# EasyEDA Pro project ProProject_IMUSensorNodes202312.epro, board 6_6_拼板20240123（不带编号） (continued)
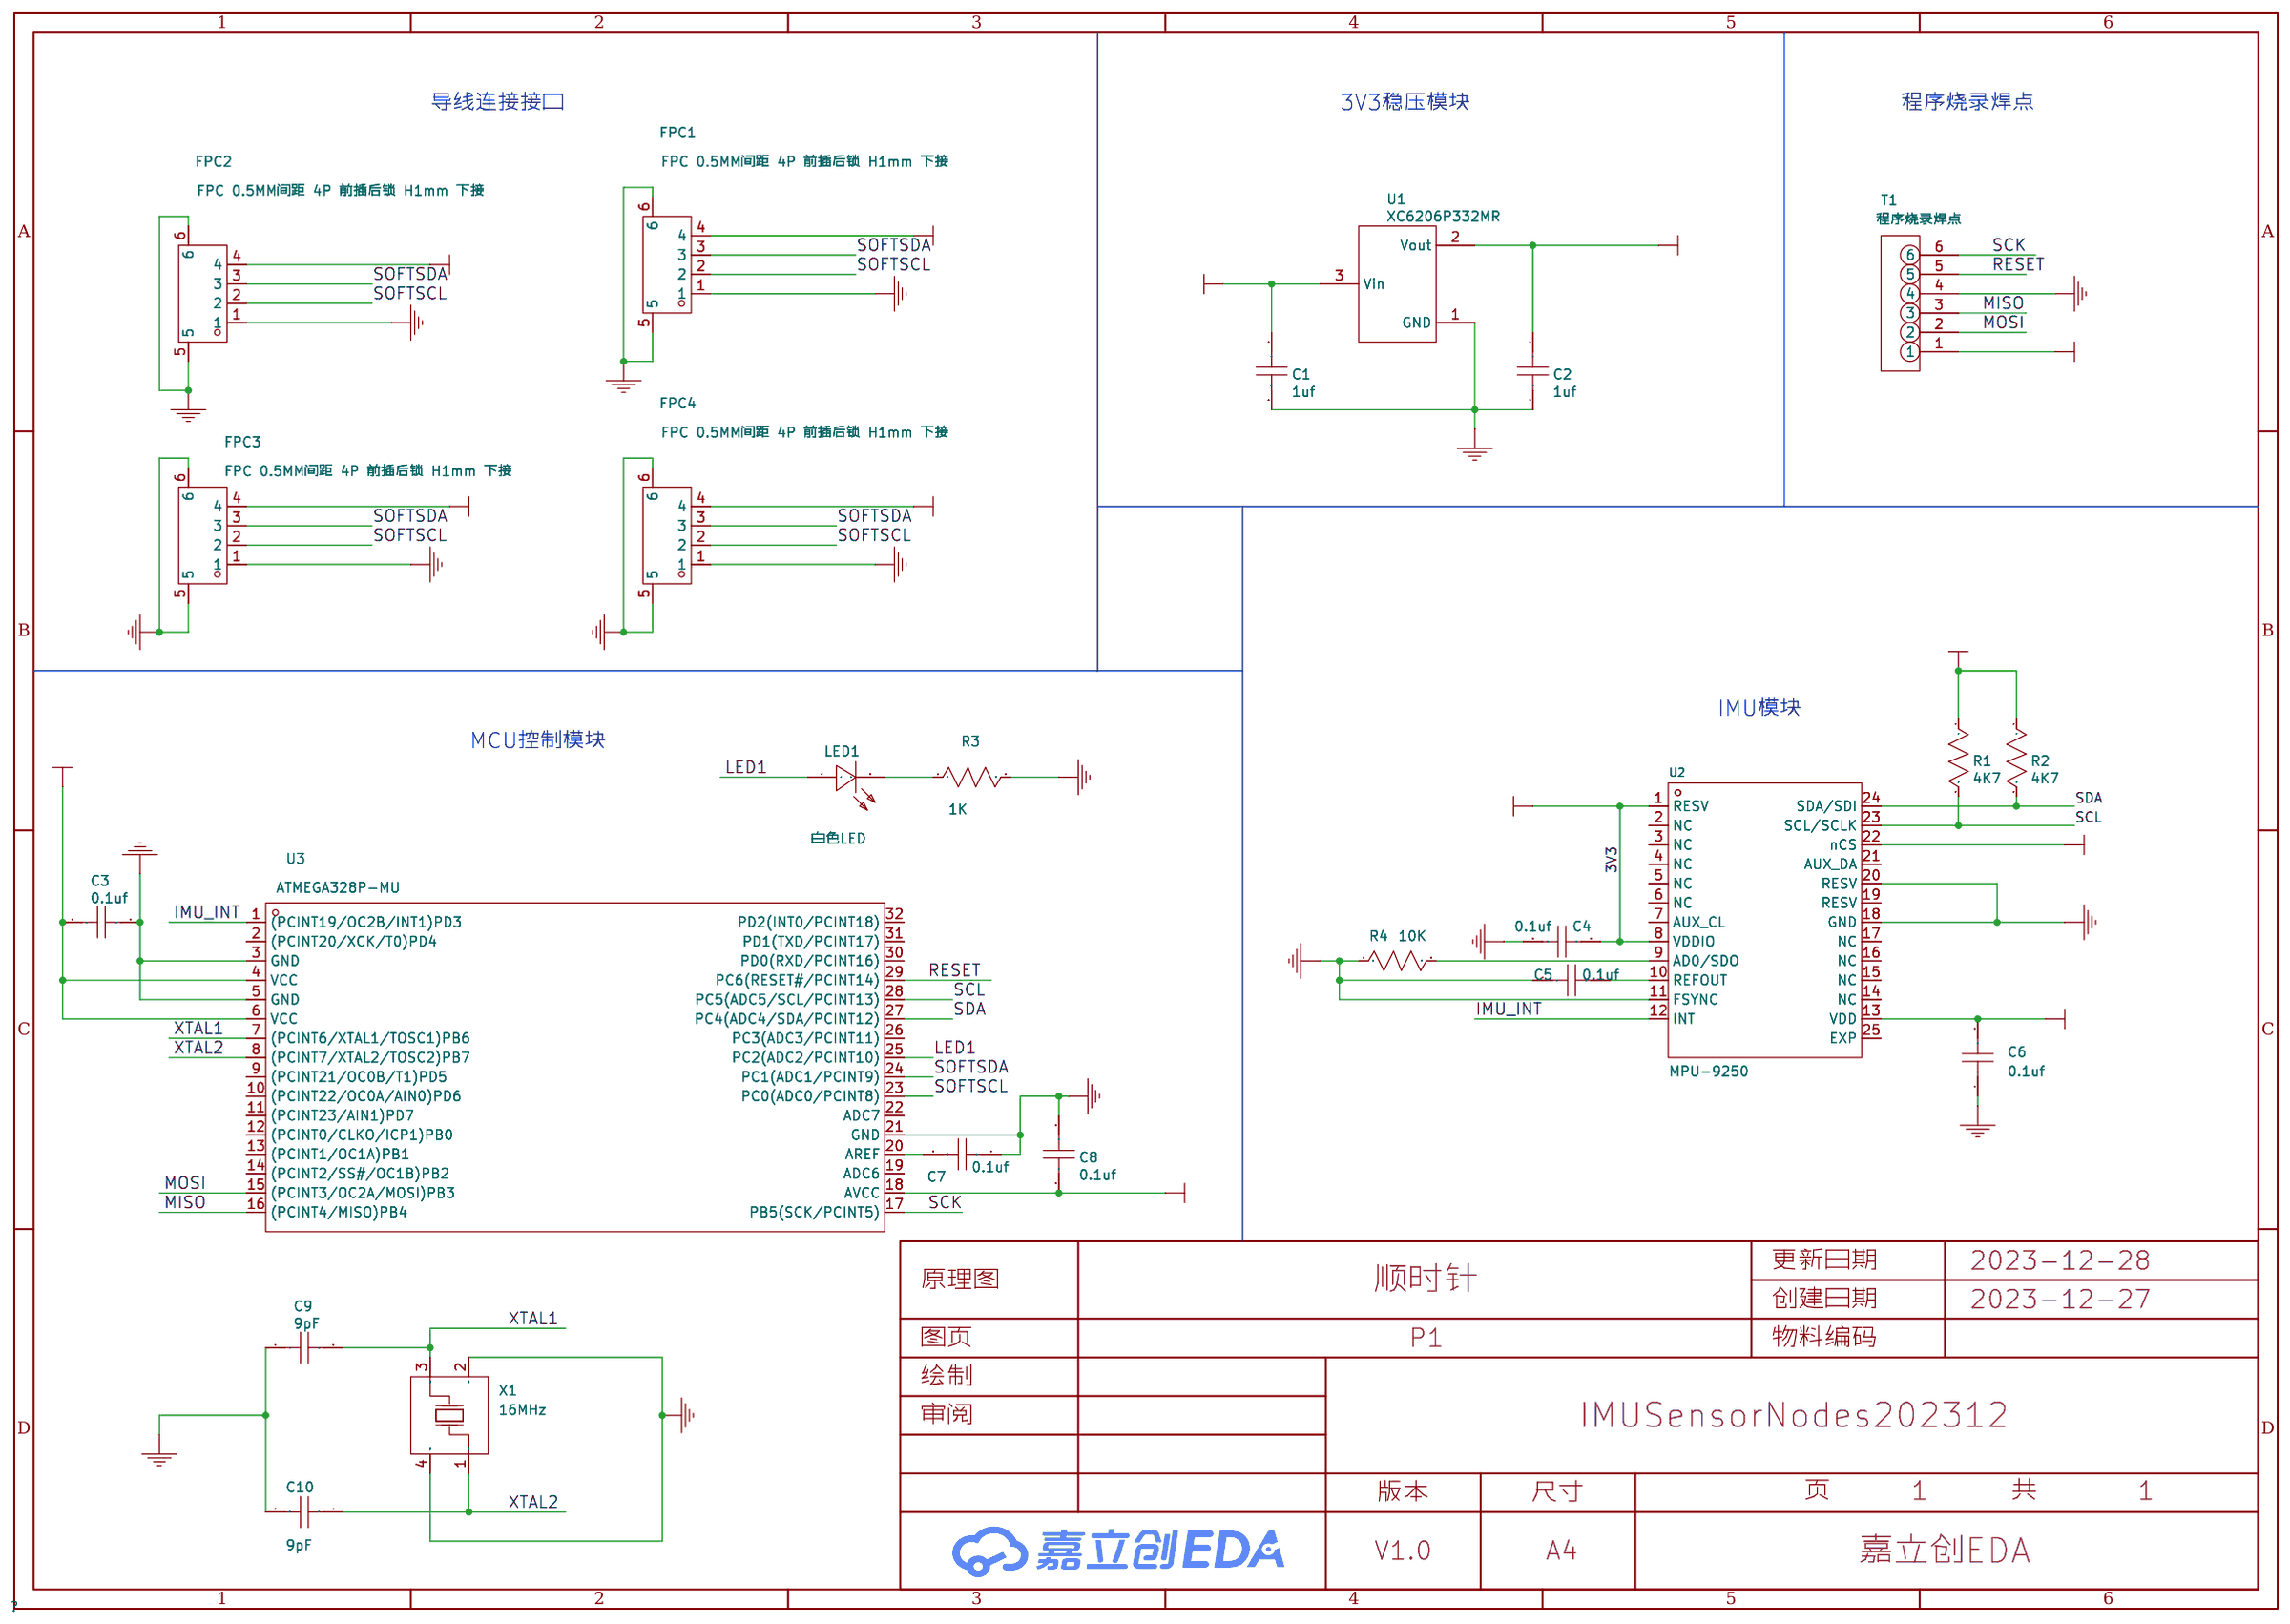
[diagram p0: schematic sheet]
## Routing (per net, layer and track width the routed paths; a pad name or vN(x,y) marks a point on that pad's centre or on a via; arc(x,y) is an arc through that point) (continued)
LED1:
  vias: v1(1.17,70.77) v1(1.17,57.05) v1(1.17,43.34) v1(1.17,29.62) v1(1.17,15.9) v1(1.17,2.19) v1(15.14,70.39) v1(15.14,56.67) v1(15.14,42.95) v1(15.14,29.24) v1(15.14,15.52) v1(15.14,1.81) v1(28.48,70.77) v1(28.48,57.05) v1(28.48,43.34) v1(28.48,29.62) v1(28.48,15.9) v1(28.48,2.19) v1(42.45,70.39) v1(42.45,56.67) v1(42.45,42.95) v1(42.45,29.24) v1(42.45,15.52) v1(42.45,1.81) v1(55.78,70.77) v1(55.78,57.05) v1(55.78,43.34) v1(55.78,29.62) v1(55.78,15.9) v1(55.78,2.19) v1(69.75,70.39) v1(69.75,56.67) v1(69.75,42.95) v1(69.75,29.24) v1(69.75,15.52) v1(69.75,1.81)
MISO:
  vias: v1(9.4,70.44) v1(9.4,56.72) v1(9.4,43) v1(9.4,29.29) v1(9.4,15.57) v1(9.4,1.86) v1(23.12,70.44) v1(23.12,56.72) v1(23.12,43) v1(23.12,29.29) v1(23.12,15.57) v1(23.12,1.86) v1(36.71,70.44) v1(36.71,56.72) v1(36.71,43) v1(36.71,29.29) v1(36.71,15.57) v1(36.71,1.86) v1(50.42,70.44) v1(50.42,56.72) v1(50.42,43) v1(50.42,29.29) v1(50.42,15.57) v1(50.42,1.86) v1(64.01,70.44) v1(64.01,56.72) v1(64.01,43) v1(64.01,29.29) v1(64.01,15.57) v1(64.01,1.86) v1(77.73,70.44) v1(77.73,56.72) v1(77.73,43) v1(77.73,29.29) v1(77.73,15.57) v1(77.73,1.86)
MOSI:
  vias: v1(9.4,71.71) v1(9.4,57.99) v1(9.4,44.27) v1(9.4,30.56) v1(9.4,16.84) v1(9.4,3.13) v1(23.12,71.71) v1(23.12,57.99) v1(23.12,44.27) v1(23.12,30.56) v1(23.12,16.84) v1(23.12,3.13) v1(36.71,71.71) v1(36.71,57.99) v1(36.71,44.27) v1(36.71,30.56) v1(36.71,16.84) v1(36.71,3.13) v1(50.42,71.71) v1(50.42,57.99) v1(50.42,44.27) v1(50.42,30.56) v1(50.42,16.84) v1(50.42,3.13) v1(64.01,71.71) v1(64.01,57.99) v1(64.01,44.27) v1(64.01,30.56) v1(64.01,16.84) v1(64.01,3.13) v1(77.73,71.71) v1(77.73,57.99) v1(77.73,44.27) v1(77.73,30.56) v1(77.73,16.84) v1(77.73,3.13)
RESET: length 163.4
  Top Layer w0.2: 77.88,55.53 78.39,56.04 78.39,57.38 v1(79,57.99) ; 50.58,0.66 51.09,1.17 51.09,2.52 v1(51.69,3.13) ; v1(79,44.27) 78.39,43.67 78.39,42.32 77.88,41.81 ; 77.88,28.1 78.39,28.6 78.39,29.95 v1(79,30.56) ; 77.88,14.38 78.39,14.89 78.39,16.23 v1(79,16.84) ; 23.27,69.24 23.78,69.75 23.78,71.1 v1(24.39,71.71) ; v1(70.52,72.93) 70.77,72.67 70.77,70.64 70.23,70.11 70.23,69.65 70.64,69.24 72.27,69.24 FPC4#16.5 ; FPC4#4.5 17.66,55.53 16.03,55.53 15.62,55.94 15.62,56.39 16.16,56.92 16.16,58.96 v1(15.91,59.21) ; v1(24.39,16.84) 23.78,16.23 23.78,14.89 23.27,14.38 ; FPC4#24.5 44.96,28.1 43.34,28.1 42.93,28.5 42.93,28.96 43.47,29.49 43.47,31.53 v1(43.21,31.78) ; v1(70.52,31.78) 70.77,31.53 70.77,29.49 70.23,28.96 70.23,28.5 70.64,28.1 72.27,28.1 FPC4#29.5 ; FPC4#2.5 44.96,0.66 43.34,0.66 42.93,1.07 42.93,1.53 43.47,2.06 43.47,4.09 v1(43.21,4.35) ; 50.58,41.81 51.09,42.32 51.09,43.67 v1(51.69,44.27) ; 50.58,28.1 51.09,28.6 51.09,29.95 v1(51.69,30.56) ; FPC4#28.5 17.66,14.38 16.03,14.38 15.62,14.79 15.62,15.24 16.16,15.78 16.16,17.81 v1(15.91,18.06) ; v1(79,71.71) 78.39,71.1 78.39,69.75 77.88,69.24 ; v1(51.69,16.84) 51.09,16.23 51.09,14.89 50.58,14.38 ; v1(24.39,3.13) 23.78,2.52 23.78,1.17 23.27,0.66 ; FPC4#10.5 44.96,41.81 43.34,41.81 42.93,42.22 42.93,42.67 43.47,43.21 43.47,45.24 v1(43.21,45.5) ; 77.88,0.66 78.39,1.17 78.39,2.52 v1(79,3.13) ; FPC4#26.5 17.66,69.24 16.03,69.24 15.62,69.65 15.62,70.11 16.16,70.64 16.16,72.67 v1(15.91,72.93) ; 50.58,69.24 51.09,69.75 51.09,71.1 v1(51.69,71.71) ; FPC4#34.5 17.66,0.66 16.03,0.66 15.62,1.07 15.62,1.53 16.16,2.06 16.16,4.09 v1(15.91,4.35) ; v1(15.91,31.78) 16.16,31.53 16.16,29.49 15.62,28.96 15.62,28.5 16.03,28.1 17.66,28.1 FPC4#15.5 ; v1(43.21,72.93) 43.47,72.67 43.47,70.64 42.93,70.11 42.93,69.65 43.34,69.24 44.96,69.24 FPC4#14.5 ; 23.27,28.1 23.78,28.6 23.78,29.95 v1(24.39,30.56) ; v1(70.52,45.5) 70.77,45.24 70.77,43.21 70.23,42.67 70.23,42.22 70.64,41.81 72.27,41.81 FPC4#20.5 ; v1(24.39,44.27) 23.78,43.67 23.78,42.32 23.27,41.81 ; v1(24.39,57.99) 23.78,57.38 23.78,56.04 23.27,55.53 ; v1(43.21,18.06) 43.47,17.81 43.47,15.78 42.93,15.24 42.93,14.79 43.34,14.38 44.96,14.38 FPC4#32.5 ; FPC4#22.5 17.66,41.81 16.03,41.81 15.62,42.22 15.62,42.67 16.16,43.21 16.16,45.24 v1(15.91,45.5) ; v1(51.69,57.99) 51.09,57.38 51.09,56.04 50.58,55.53 ; v1(70.52,59.21) 70.77,58.96 70.77,56.92 70.23,56.39 70.23,55.94 70.64,55.53 72.27,55.53 FPC4#9.5 ; FPC4#31.5 72.27,14.38 70.64,14.38 70.23,14.79 70.23,15.24 70.77,15.78 70.77,17.81 v1(70.52,18.06) ; FPC4#5.5 72.27,0.66 70.64,0.66 70.23,1.07 70.23,1.53 70.77,2.06 70.77,4.09 v1(70.52,4.35) ; v1(43.21,59.21) 43.47,58.96 43.47,56.92 42.93,56.39 42.93,55.94 43.34,55.53 44.96,55.53 FPC4#21.5
  vias: v1(2.32,72.84) v1(2.32,59.12) v1(2.32,45.41) v1(2.32,31.69) v1(2.32,17.97) v1(2.32,4.26) v1(10.67,71.71) v1(10.67,57.99) v1(10.67,44.27) v1(10.67,30.56) v1(10.67,16.84) v1(10.67,3.13) v1(29.62,72.84) v1(29.62,59.12) v1(29.62,45.41) v1(29.62,31.69) v1(29.62,17.97) v1(29.62,4.26) v1(37.98,71.71) v1(37.98,57.99) v1(37.98,44.27) v1(37.98,30.56) v1(37.98,16.84) v1(37.98,3.13) v1(56.93,72.84) v1(56.93,59.12) v1(56.93,45.41) v1(56.93,31.69) v1(56.93,17.97) v1(56.93,4.26) v1(65.28,71.71) v1(65.28,57.99) v1(65.28,44.27) v1(65.28,30.56) v1(65.28,16.84) v1(65.28,3.13)
SCK: length 93.7
  Bottom Layer w0.2: U3#94.17 74.55,15.4 76.87,15.4 77.25,15.01 78.77,15.01 79,15.24 v1(79,15.57) ; U3#79.17 47.24,29.11 49.56,29.11 49.94,28.73 51.47,28.73 51.69,28.96 v1(51.69,29.29) ; U3#67.17 74.55,42.83 76.87,42.83 77.25,42.45 78.77,42.45 79,42.67 v1(79,43) ; v1(24.39,43) 24.39,42.67 24.16,42.45 22.64,42.45 22.26,42.83 19.94,42.83 U3#84.17 ; U3#87.17 74.55,29.11 76.87,29.11 77.25,28.73 78.77,28.73 79,28.96 v1(79,29.29) ; U3#69.17 47.24,70.26 49.56,70.26 49.94,69.88 51.47,69.88 51.69,70.11 v1(51.69,70.44) ; U3#83.17 74.55,70.26 76.87,70.26 77.25,69.88 78.77,69.88 79,70.11 v1(79,70.44) ; v1(79,1.86) 79,1.53 78.77,1.3 77.25,1.3 76.87,1.68 74.55,1.68 U3#80.17 ; v1(24.39,1.86) 24.39,1.53 24.16,1.3 22.64,1.3 22.26,1.68 19.94,1.68 U3#90.17 ; U3#95.17 19.94,15.4 22.26,15.4 22.64,15.01 24.16,15.01 24.39,15.24 v1(24.39,15.57) ; U3#71.17 19.94,70.26 22.26,70.26 22.64,69.88 24.16,69.88 24.39,70.11 v1(24.39,70.44) ; v1(51.69,56.72) 51.69,56.39 51.47,56.16 49.94,56.16 49.56,56.54 47.24,56.54 U3#78.17 ; U3#61.17 74.55,56.54 76.87,56.54 77.25,56.16 78.77,56.16 79,56.39 v1(79,56.72) ; U3#88.17 19.94,56.54 22.26,56.54 22.64,56.16 24.16,56.16 24.39,56.39 v1(24.39,56.72) ; U3#86.17 47.24,1.68 49.56,1.68 49.94,1.3 51.47,1.3 51.69,1.53 v1(51.69,1.86) ; U3#64.17 47.24,42.83 49.56,42.83 49.94,42.45 51.47,42.45 51.69,42.67 v1(51.69,43) ; v1(51.69,15.57) 51.69,15.24 51.47,15.01 49.94,15.01 49.56,15.4 47.24,15.4 U3#62.17 ; U3#81.17 19.94,29.11 22.26,29.11 22.64,28.73 24.16,28.73 24.39,28.96 v1(24.39,29.29)
  vias: v1(10.67,70.44) v1(10.67,56.72) v1(10.67,43) v1(10.67,29.29) v1(10.67,15.57) v1(10.67,1.86) v1(37.98,70.44) v1(37.98,56.72) v1(37.98,43) v1(37.98,29.29) v1(37.98,15.57) v1(37.98,1.86) v1(65.28,70.44) v1(65.28,56.72) v1(65.28,43) v1(65.28,29.29) v1(65.28,15.57) v1(65.28,1.86)
SCL: length 301.1
  Bottom Layer w0.2: U3#89.28 56.03,44.86 55.66,45.24 55.66,49.81 56.7,50.85 R1#34.2 56.92,51.17 U2#26.23 ; U3#91.28 1.42,3.72 1.05,4.09 1.05,8.66 2.09,9.71 R1#13.2 2.31,10.03 U2#11.23 ; U3#82.28 56.03,31.15 55.66,31.53 55.66,36.1 56.7,37.14 R1#4.2 56.92,37.46 U2#10.23 ; U3#65.28 1.42,31.15 1.05,31.53 1.05,36.1 2.09,37.14 R1#36.2 2.31,37.46 U2#4.23 ; U3#77.28 28.73,72.3 28.35,72.67 28.35,77.25 29.39,78.29 R1#22.2 29.61,78.61 U2#27.23 ; U2#15.23 56.92,78.61 R1#20.2 56.7,78.29 55.66,77.25 55.66,72.67 56.03,72.3 U3#66.28 ; U2#8.23 29.61,37.46 R1#2.2 29.39,37.14 28.35,36.1 28.35,31.53 28.73,31.15 U3#70.28 ; U2#25.23 29.61,10.03 R1#15.2 29.39,9.71 28.35,8.66 28.35,4.09 28.73,3.72 U3#92.28 ; U3#75.28 28.73,44.86 28.35,45.24 28.35,49.81 29.39,50.85 R1#32.2 29.61,51.17 U2#21.23 ; U3#68.28 1.42,44.86 1.05,45.24 1.05,49.81 2.09,50.85 R1#30.2 2.31,51.17 U2#30.23 ; U2#33.23 2.31,23.74 R1#7.2 2.09,23.42 1.05,22.38 1.05,17.81 1.42,17.43 U3#72.28 ; U2#31.23 29.61,64.89 R1#26.2 29.39,64.57 28.35,63.53 28.35,58.96 28.73,58.58 U3#76.28 ; U2#29.23 2.31,64.89 R1#24.2 2.09,64.57 1.05,63.53 1.05,58.96 1.42,58.58 U3#74.28 ; U3#73.28 28.73,17.43 28.35,17.81 28.35,22.38 29.39,23.42 R1#9.2 29.61,23.74 U2#9.23 ; U2.23 2.31,78.61 R1#19.2 2.09,78.29 1.05,77.25 1.05,72.67 1.42,72.3 U3#96.28 ; U3#63.28 56.03,58.58 55.66,58.96 55.66,63.53 56.7,64.57 R1#28.2 56.92,64.89 U2#13.23 ; U3#93.28 56.03,17.43 55.66,17.81 55.66,22.38 56.7,23.42 R1#11.2 56.92,23.74 U2#17.23 ; U2#23.23 56.92,10.03 R1#17.2 56.7,9.71 55.66,8.66 55.66,4.09 56.03,3.72 U3#85.28
  Bottom Layer w0.254: U3#79.28 42.44,31.15 41.92,31.68 41.92,35.69 43.36,37.14 R1#3.2 43.47,37.24 43.68,37.46 U2#3.23 ; U3#81.28 15.14,31.15 14.61,31.68 14.61,35.69 16.06,37.14 R1.2 16.16,37.24 16.38,37.46 U2#28.23 ; U3#83.28 69.75,72.3 69.22,72.83 69.22,76.84 70.67,78.29 R1#6.2 70.77,78.39 70.99,78.61 U2#36.23 ; U3#87.28 69.75,31.15 69.22,31.68 69.22,35.69 70.67,37.14 R1#5.2 70.77,37.24 70.99,37.46 U2#16.23 ; U2#19.23 43.68,10.03 43.47,9.81 R1#16.2 43.36,9.71 41.92,8.26 41.92,4.25 42.44,3.72 U3#86.28 ; U3#80.28 69.75,3.72 69.22,4.25 69.22,8.26 70.67,9.71 R1#18.2 70.77,9.81 70.99,10.03 U2#20.23 ; U2#14.23 16.38,51.17 16.16,50.96 R1#31.2 16.06,50.85 14.61,49.41 14.61,45.39 15.14,44.86 U3#84.28 ; U2#32.23 70.99,64.89 70.77,64.67 R1#29.2 70.67,64.57 69.22,63.12 69.22,59.11 69.75,58.58 U3#61.28 ; U2#35.23 70.99,23.74 70.77,23.52 R1#12.2 70.67,23.42 69.22,21.97 69.22,17.96 69.75,17.43 U3#94.28 ; U3#62.28 42.44,17.43 41.92,17.96 41.92,21.97 43.36,23.42 R1#10.2 43.47,23.52 43.68,23.74 U2#2.23 ; U3#69.28 42.44,72.3 41.92,72.83 41.92,76.84 43.36,78.29 R1#23.2 43.47,78.39 43.68,78.61 U2#24.23 ; U2#18.23 16.38,10.03 16.16,9.81 R1#14.2 16.06,9.71 14.61,8.26 14.61,4.25 15.14,3.72 U3#90.28 ; U2#6.23 70.99,51.17 70.77,50.96 R1#35.2 70.67,50.85 69.22,49.41 69.22,45.39 69.75,44.86 U3#67.28 ; U2#7.23 16.38,78.61 16.16,78.39 R1#21.2 16.06,78.29 14.61,76.84 14.61,72.83 15.14,72.3 U3#71.28 ; U3#88.28 15.14,58.58 14.61,59.11 14.61,63.12 16.06,64.57 R1#25.2 16.16,64.67 16.38,64.89 U2#12.23 ; U3#95.28 15.14,17.43 14.61,17.96 14.61,21.97 16.06,23.42 R1#8.2 16.16,23.52 16.38,23.74 U2#22.23 ; U3#78.28 42.44,58.58 41.92,59.11 41.92,63.12 43.36,64.57 R1#27.2 43.47,64.67 43.68,64.89 U2#34.23 ; U3#64.28 42.44,44.86 41.92,45.39 41.92,49.41 43.36,50.85 R1#33.2 43.47,50.96 43.68,51.17 U2#5.23
SDA: length 420.6
  Bottom Layer w0.2: U2#26.24 57.14,51.58 ; 57.14,51.58 56.72,51.58 ; 57.14,51.58 arc(56.83,51.7) 56.7,52.02 ; 56.72,24.14 56.7,24.16 56.7,24.59 ; 56.72,24.14 56.24,24.14 ; 56.72,24.14 57.14,24.14 ; 56.7,38.32 56.7,38.3 ; 56.7,38.32 R2#4.2 ; 56.7,38.32 arc(56.56,37.99) 56.24,37.86 ; 56.7,38.3 56.7,37.88 56.72,37.86 ; 56.7,38.3 arc(56.83,37.99) 57.14,37.86 ; 29.84,51.58 29.41,51.58 ; 29.84,51.58 U2#21.24 ; 29.84,51.58 arc(29.52,51.7) 29.39,52.02 ; 29.41,51.58 29.39,51.6 29.39,52.02 ; 29.41,51.58 28.93,51.58 ; 56.72,65.29 56.24,65.29 ; 56.72,65.29 56.7,65.31 56.7,65.73 ; 56.72,65.29 57.14,65.29 ; 56.24,65.29 56.02,65.29 55.66,64.93 55.48,64.93 55.15,64.6 55.15,58.96 56.03,58.08 U3#63.27 ; 56.24,65.29 arc(56.56,65.43) 56.7,65.75 ; 29.41,37.86 28.93,37.86 ; 29.41,37.86 29.39,37.88 29.39,38.3 ; 29.41,37.86 29.84,37.86 ; 28.93,37.86 28.72,37.86 28.35,37.49 28.17,37.49 27.84,37.17 27.84,31.53 28.72,30.65 U3#70.27 ; 28.93,37.86 arc(29.26,37.99) 29.39,38.32 ; 56.7,52.02 56.7,51.6 56.72,51.58 ; 56.7,52.02 56.7,52.04 ; 29.41,79.01 29.39,79.03 29.39,79.45 ; 29.41,79.01 28.93,79.01 ; 29.41,79.01 29.84,79.01 ; 56.24,79.01 56.02,79.01 55.66,78.64 55.48,78.64 55.15,78.31 55.15,72.67 56.03,71.8 U3#66.27 ; 56.24,79.01 56.72,79.01 ; 56.24,79.01 arc(56.56,79.14) 56.7,79.47 ; 29.39,24.6 29.39,24.59 ; 29.39,24.6 R2#9.2 ; 29.39,24.6 arc(29.26,24.28) 28.93,24.14 ; 29.39,24.59 29.39,24.16 29.41,24.14 ; 29.39,24.59 arc(29.52,24.27) 29.84,24.14 ; U3#85.27 56.03,3.22 55.15,4.09 55.15,9.73 55.48,10.06 55.66,10.06 56.02,10.43 56.24,10.43 ; 56.7,79.47 56.7,79.45 ; 56.7,79.47 R2#20.2 ; 56.7,79.45 56.7,79.03 56.72,79.01 ; 56.7,79.45 arc(56.83,79.14) 57.14,79.01 ; U3#65.27 1.42,30.65 0.54,31.53 0.54,37.17 0.87,37.49 1.05,37.49 1.41,37.86 1.63,37.86 ; R2#32.2 29.39,52.04 ; 29.39,52.04 29.39,52.02 ; 29.39,52.04 arc(29.26,51.71) 28.93,51.58 ; 2.09,52.02 2.09,51.6 2.11,51.58 ; 2.09,52.02 2.09,52.04 ; 2.09,52.02 arc(2.22,51.7) 2.53,51.58 ; 29.39,38.32 29.39,38.3 ; 29.39,38.32 R2#2.2 ; 29.39,38.3 arc(29.52,37.99) 29.84,37.86 ; U3#93.27 56.03,16.93 55.15,17.81 55.15,23.45 55.48,23.78 55.66,23.78 56.02,24.14 56.24,24.14 ; 56.7,24.59 56.7,24.6 ; 56.7,24.59 arc(56.83,24.27) 57.14,24.14 ; U3#82.27 56.03,30.65 55.15,31.53 55.15,37.17 55.48,37.49 55.66,37.49 56.02,37.86 56.24,37.86 ; R2#22.2 29.39,79.47 ; 29.39,79.47 29.39,79.45 ; 29.39,79.47 arc(29.26,79.14) 28.93,79.01 ; 29.39,65.75 29.39,65.73 ; 29.39,65.75 R2#26.2 ; 29.39,65.75 arc(29.26,65.43) 28.93,65.29 ; 29.39,65.73 29.39,65.31 29.41,65.29 ; 29.39,65.73 arc(29.52,65.42) 29.84,65.29 ; 2.09,10.89 2.09,10.87 ; 2.09,10.89 R2#13.2 ; 2.09,10.89 arc(1.95,10.56) 1.63,10.43 ; 2.09,10.87 2.09,10.45 2.11,10.43 ; 2.09,10.87 arc(2.22,10.56) 2.53,10.43 ; 1.63,24.14 1.41,24.14 1.05,23.78 0.87,23.78 0.54,23.45 0.54,17.81 1.42,16.93 U3#72.27 ; 1.63,24.14 2.11,24.14 ; 1.63,24.14 arc(1.95,24.28) 2.09,24.6 ; 56.24,10.43 56.72,10.43 ; 56.24,10.43 arc(56.56,10.56) 56.7,10.89 ; 2.09,24.59 2.09,24.16 2.11,24.14 ; 2.09,24.59 2.09,24.6 ; 2.09,24.59 arc(2.22,24.27) 2.53,24.14 ; 2.11,79.01 1.63,79.01 ; 2.11,79.01 2.09,79.03 2.09,79.45 ; 2.11,79.01 2.53,79.01 ; 1.63,79.01 1.41,79.01 1.05,78.64 0.87,78.64 0.54,78.31 0.54,72.67 1.42,71.8 U3#96.27 ; 1.63,79.01 arc(1.95,79.14) 2.09,79.47 ; 56.7,65.75 56.7,65.73 ; 56.7,65.75 R2#28.2 ; 56.7,65.73 arc(56.83,65.42) 57.14,65.29 ; 56.72,37.86 57.14,37.86 ; 56.72,37.86 56.24,37.86 ; 29.39,10.87 29.39,10.45 29.41,10.43 ; 29.39,10.87 29.39,10.89 ; 29.39,10.87 arc(29.52,10.56) 29.84,10.43 ; 56.72,10.43 56.7,10.45 56.7,10.87 ; 56.72,10.43 57.14,10.43 ; 2.11,10.43 1.63,10.43 ; 2.11,10.43 2.53,10.43 ; 1.63,10.43 1.41,10.43 1.05,10.06 0.87,10.06 0.54,9.73 0.54,4.09 1.42,3.22 U3#91.27 ; 57.14,10.43 U2#23.24 ; 57.14,10.43 arc(56.83,10.56) 56.7,10.87 ; 29.41,65.29 28.93,65.29 ; 29.41,65.29 29.84,65.29 ; 56.24,24.14 arc(56.56,24.28) 56.7,24.6 ; U3#74.27 1.42,58.08 0.54,58.96 0.54,64.6 0.87,64.93 1.05,64.93 1.41,65.29 1.63,65.29 ; U3#92.27 28.72,3.22 27.84,4.09 27.84,9.73 28.17,10.06 28.35,10.06 28.72,10.43 28.93,10.43 ; 28.93,51.58 28.72,51.58 28.35,51.21 28.17,51.21 27.84,50.88 27.84,45.24 28.72,44.36 U3#75.27 ; U2#13.24 57.14,65.29 ; U2#31.24 29.84,65.29 ; 2.11,65.29 1.63,65.29 ; 2.11,65.29 2.09,65.31 2.09,65.73 ; 2.11,65.29 2.53,65.29 ; 1.63,65.29 arc(1.95,65.43) 2.09,65.75 ; U2#29.24 2.53,65.29 ; 2.53,65.29 arc(2.22,65.42) 2.09,65.73 ; U3#77.27 28.72,71.8 27.84,72.67 27.84,78.31 28.17,78.64 28.35,78.64 28.72,79.01 28.93,79.01 ; 57.14,79.01 56.72,79.01 ; 57.14,79.01 U2#15.24 ; U3#89.27 56.03,44.36 55.15,45.24 55.15,50.88 55.48,51.21 55.66,51.21 56.02,51.58 56.24,51.58 ; 2.53,10.43 U2#11.24 ; R2#11.2 56.7,24.6 ; U2#10.24 57.14,37.86 ; U2#33.24 2.53,24.14 ; 2.53,24.14 2.11,24.14 ; 2.11,37.86 1.63,37.86 ; 2.11,37.86 2.09,37.88 2.09,38.3 ; 2.11,37.86 2.53,37.86 ; 1.63,37.86 arc(1.95,37.99) 2.09,38.32 ; U2#9.24 29.84,24.14 ; 29.84,24.14 29.41,24.14 ; 28.93,10.43 29.41,10.43 ; 28.93,10.43 arc(29.26,10.56) 29.39,10.89 ; R2#15.2 29.39,10.89 ; U2#4.24 2.53,37.86 ; 2.53,37.86 arc(2.22,37.99) 2.09,38.3 ; R2#19.2 2.09,79.47 ; 2.09,79.47 2.09,79.45 ; 56.7,10.89 56.7,10.87 ; 56.7,10.89 R2#17.2 ; U2#27.24 29.84,79.01 ; 29.84,79.01 arc(29.52,79.14) 29.39,79.45 ; U3#76.27 28.72,58.08 27.84,58.96 27.84,64.6 28.17,64.93 28.35,64.93 28.72,65.29 28.93,65.29 ; 29.84,37.86 U2#8.24 ; 29.41,24.14 28.93,24.14 ; 56.72,51.58 56.24,51.58 ; 56.24,51.58 arc(56.56,51.71) 56.7,52.04 ; 2.09,38.3 2.09,38.32 ; 29.41,10.43 29.84,10.43 ; 2.53,51.58 2.11,51.58 ; 2.53,51.58 U2#30.24 ; 2.11,51.58 1.63,51.58 ; 2.09,79.45 arc(2.22,79.14) 2.53,79.01 ; 28.93,24.14 28.72,24.14 28.35,23.78 28.17,23.78 27.84,23.45 27.84,17.81 28.72,16.93 U3#73.27 ; 2.09,52.04 R2#30.2 ; 2.09,52.04 arc(1.95,51.71) 1.63,51.58 ; 56.7,52.04 R2#34.2 ; U2.24 2.53,79.01 ; U3#68.27 1.42,44.36 0.54,45.24 0.54,50.88 0.87,51.21 1.05,51.21 1.41,51.58 1.63,51.58 ; R2#36.2 2.09,38.32 ; U2#25.24 29.84,10.43 ; 2.09,65.73 2.09,65.75 ; R2#7.2 2.09,24.6 ; 57.14,24.14 U2#17.24 ; 2.09,65.75 R2#24.2
  Bottom Layer w0.254: 16.46,65.29 16.27,65.29 16.16,65.18 14.64,65.18 14.25,64.8 14.25,58.83 15,58.08 U3#88.27 ; 16.46,65.29 U2#12.24 ; 16.46,65.29 R2#25.2 ; U3#62.27 42.31,16.93 41.56,17.68 41.56,23.65 41.94,24.03 43.47,24.03 43.58,24.14 43.76,24.14 ; 43.76,65.29 R2#27.2 ; 43.76,65.29 43.58,65.29 43.47,65.18 41.94,65.18 41.56,64.8 41.56,58.83 42.31,58.08 U3#78.27 ; 43.76,65.29 U2#34.24 ; U3#87.27 69.62,30.65 68.87,31.4 68.87,37.37 69.25,37.75 70.77,37.75 70.88,37.86 71.07,37.86 ; U3#69.27 42.31,71.8 41.56,72.55 41.56,78.52 41.94,78.9 43.47,78.9 43.58,79.01 43.76,79.01 ; 16.46,24.14 16.27,24.14 16.16,24.03 14.64,24.03 14.25,23.65 14.25,17.68 15,16.93 U3#95.27 ; 16.46,24.14 R2#8.2 ; 16.46,24.14 U2#22.24 ; U3#90.27 15,3.22 14.25,3.97 14.25,9.94 14.64,10.32 16.16,10.32 16.27,10.43 16.46,10.43 ; U3#81.27 15,30.65 14.25,31.4 14.25,37.37 14.64,37.75 16.16,37.75 16.27,37.86 16.46,37.86 ; U2#6.24 71.07,51.58 ; 71.07,51.58 R2#35.2 ; 71.07,51.58 70.88,51.58 70.77,51.46 69.25,51.46 68.87,51.08 68.87,45.11 69.62,44.36 U3#67.27 ; U3#64.27 42.31,44.36 41.56,45.11 41.56,51.08 41.94,51.46 43.47,51.46 43.58,51.58 43.76,51.58 ; U3#61.27 69.62,58.08 68.87,58.83 68.87,64.8 69.25,65.18 70.77,65.18 70.88,65.29 71.07,65.29 ; U3#83.27 69.62,71.8 68.87,72.55 68.87,78.52 69.25,78.9 70.77,78.9 70.88,79.01 71.07,79.01 ; 71.07,10.43 R2#18.2 ; 71.07,10.43 U2#20.24 ; 71.07,10.43 70.88,10.43 70.77,10.32 69.25,10.32 68.87,9.94 68.87,3.97 69.62,3.22 U3#80.27 ; U2#3.24 43.76,37.86 ; 43.76,37.86 R2#3.2 ; 43.76,37.86 43.58,37.86 43.47,37.75 41.94,37.75 41.56,37.37 41.56,31.4 42.31,30.65 U3#79.27 ; 43.76,24.14 R2#10.2 ; 43.76,24.14 U2#2.24 ; 16.46,37.86 R2.2 ; 16.46,37.86 U2#28.24 ; U2#35.24 71.07,24.14 ; 71.07,24.14 70.88,24.14 70.77,24.03 69.25,24.03 68.87,23.65 68.87,17.68 69.62,16.93 U3#94.27 ; 71.07,24.14 R2#12.2 ; U2#24.24 43.76,79.01 ; 43.76,79.01 R2#23.2 ; U2#19.24 43.76,10.43 ; 43.76,10.43 R2#16.2 ; 43.76,10.43 43.58,10.43 43.47,10.32 41.94,10.32 41.56,9.94 41.56,3.97 42.31,3.22 U3#86.27 ; 71.07,65.29 R2#29.2 ; 71.07,65.29 U2#32.24 ; 16.46,51.58 R2#31.2 ; 16.46,51.58 U2#14.24 ; 16.46,51.58 16.27,51.58 16.16,51.46 14.64,51.46 14.25,51.08 14.25,45.11 15,44.36 U3#84.27 ; U2#36.24 71.07,79.01 ; 71.07,79.01 R2#6.2 ; U2#16.24 71.07,37.86 ; 71.07,37.86 R2#5.2 ; U2#7.24 16.46,79.01 ; 16.46,79.01 16.27,79.01 16.16,78.9 14.64,78.9 14.25,78.52 14.25,72.55 15,71.8 U3#71.27 ; 16.46,79.01 R2#21.2 ; 16.46,10.43 R2#14.2 ; 16.46,10.43 U2#18.24 ; 43.76,51.58 U2#5.24 ; 43.76,51.58 R2#33.2
SOFTSCL: length 811.1
  Top Layer w0.2: FPC1#32.3 2.57,46.9 1.94,47.53 1.94,48.42 3.59,50.07 3.59,50.96 3.91,51.28 7.2,51.28 7.27,51.21 ; 7.27,10.06 7.2,10.13 3.91,10.13 3.59,9.81 3.59,8.92 1.94,7.27 1.94,6.38 2.57,5.75 FPC1#13.3 ; FPC2#16.2 47.27,23.11 46.73,23.65 45.88,23.65 45.24,23.02 45.24,20.22 44.99,19.97 44.22,19.97 FPC1#9.2 ; FPC2.2 74.58,50.55 74.04,51.08 73.18,51.08 72.55,50.45 72.55,47.65 72.29,47.4 71.53,47.4 FPC1#29.2 ; FPC2#30.2 19.97,77.98 19.43,78.52 18.57,78.52 17.94,77.88 17.94,75.09 17.68,74.83 16.92,74.83 FPC1#35.2 ; FPC1#22.2 44.22,6.25 44.99,6.25 45.24,6.51 45.24,9.3 45.88,9.94 46.73,9.94 47.27,9.4 FPC2#22.2 ; FPC2#26.2 47.27,64.26 46.73,64.8 45.88,64.8 45.24,64.16 45.24,61.37 44.99,61.12 44.22,61.12 FPC1#11.2 ; 7.27,78.64 7.2,78.71 3.91,78.71 3.59,78.39 3.59,77.5 1.94,75.85 1.94,74.96 2.57,74.33 FPC1#4.3 ; FPC1#30.2 71.53,61.12 72.29,61.12 72.55,61.37 72.55,64.16 73.18,64.8 74.04,64.8 74.58,64.26 FPC2#31.2 ; FPC1#18.3 29.87,46.9 29.24,47.53 29.24,48.42 30.89,50.07 30.89,50.96 31.21,51.28 34.51,51.28 34.57,51.21 ; FPC1#10.2 16.92,6.25 17.68,6.25 17.94,6.51 17.94,9.3 18.57,9.94 19.43,9.94 19.97,9.4 FPC2#14.2 ; FPC2#15.2 74.58,9.4 74.04,9.94 73.18,9.94 72.55,9.3 72.55,6.51 72.29,6.25 71.53,6.25 FPC1#7.2 ; FPC2#28.2 19.97,64.26 19.43,64.8 18.57,64.8 17.94,64.16 17.94,61.37 17.68,61.12 16.92,61.12 FPC1#23.2 ; FPC1#28.3 57.18,5.75 56.55,6.38 56.55,7.27 58.2,8.92 58.2,9.81 58.52,10.13 61.81,10.13 61.88,10.06 ; 34.57,37.49 34.51,37.56 31.21,37.56 30.89,37.24 30.89,36.35 29.24,34.7 29.24,33.81 29.87,33.18 FPC1#36.3 ; FPC2#5.2 19.97,23.11 19.43,23.65 18.57,23.65 17.94,23.02 17.94,20.22 17.68,19.97 16.92,19.97 FPC1#19.2 ; FPC1#26.2 44.22,33.68 44.99,33.68 45.24,33.94 45.24,36.73 45.88,37.37 46.73,37.37 47.27,36.83 FPC2#27.2 ; FPC2#29.2 19.97,50.55 19.43,51.08 18.57,51.08 17.94,50.45 17.94,47.65 17.68,47.4 16.92,47.4 FPC1#27.2 ; FPC1#25.2 71.53,19.97 72.29,19.97 72.55,20.22 72.55,23.02 73.18,23.65 74.04,23.65 74.58,23.11 FPC2#20.2 ; FPC1#31.3 29.87,74.33 29.24,74.96 29.24,75.85 30.89,77.5 30.89,78.39 31.21,78.71 34.51,78.71 34.57,78.64 ; FPC1#21.3 29.87,19.46 29.24,20.09 29.24,20.98 30.89,22.64 30.89,23.52 31.21,23.84 34.51,23.84 34.57,23.78 ; FPC1#34.3 57.18,19.46 56.55,20.09 56.55,20.98 58.2,22.64 58.2,23.52 58.52,23.84 61.81,23.84 61.88,23.78 ; 7.27,37.49 7.2,37.56 3.91,37.56 3.59,37.24 3.59,36.35 1.94,34.7 1.94,33.81 2.57,33.18 FPC1#12.3 ; 61.88,78.64 61.81,78.71 58.52,78.71 58.2,78.39 58.2,77.5 56.55,75.85 56.55,74.96 57.18,74.33 FPC1#8.3 ; FPC2#3.2 74.58,77.98 74.04,78.52 73.18,78.52 72.55,77.88 72.55,75.09 72.29,74.83 71.53,74.83 FPC1#15.2 ; 7.27,64.93 7.2,64.99 3.91,64.99 3.59,64.67 3.59,63.78 1.94,62.13 1.94,61.24 2.57,60.61 FPC1.3 ; FPC1#3.2 71.53,33.68 72.29,33.68 72.55,33.94 72.55,36.73 73.18,37.37 74.04,37.37 74.58,36.83 FPC2#18.2 ; FPC2#2.2 47.27,77.98 46.73,78.52 45.88,78.52 45.24,77.88 45.24,75.09 44.99,74.83 44.22,74.83 FPC1#20.2 ; FPC1#5.3 2.57,19.46 1.94,20.09 1.94,20.98 3.59,22.64 3.59,23.52 3.91,23.84 7.2,23.84 7.27,23.78 ; FPC1#14.3 29.87,60.61 29.24,61.24 29.24,62.13 30.89,63.78 30.89,64.67 31.21,64.99 34.51,64.99 34.57,64.93 ; FPC1#2.3 29.87,5.75 29.24,6.38 29.24,7.27 30.89,8.92 30.89,9.81 31.21,10.13 34.51,10.13 34.57,10.06 ; 61.88,64.93 61.81,64.99 58.52,64.99 58.2,64.67 58.2,63.78 56.55,62.13 56.55,61.24 57.18,60.61 FPC1#6.3 ; 61.88,37.49 61.81,37.56 58.52,37.56 58.2,37.24 58.2,36.35 56.55,34.7 56.55,33.81 57.18,33.18 FPC1#24.3 ; FPC1#17.3 57.18,46.9 56.55,47.53 56.55,48.42 58.2,50.07 58.2,50.96 58.52,51.28 61.81,51.28 61.88,51.21 ; FPC1#16.2 44.22,47.4 44.99,47.4 45.24,47.65 45.24,50.45 45.88,51.08 46.73,51.08 47.27,50.55 FPC2#24.2 ; FPC1#33.2 16.92,33.68 17.68,33.68 17.94,33.94 17.94,36.73 18.57,37.37 19.43,37.37 19.97,36.83 FPC2#17.2
  Top Layer w0.254: FPC2#17.2 19.97,35.6 20.23,35.33 23.4,35.33 24.03,34.7 24.03,33.56 23.66,33.18 FPC3#7.2 21.75,33.18 21.28,32.71 21.28,29.79 20.88,29.39 20.76,29.39 20.73,29.37 20.1,29.37 19.47,30 FPC4#15.2 ; FPC4#13.3 6.25,72.54 6.48,72.77 9.57,72.77 10.24,73.44 10.24,74.22 9.63,74.83 FPC3#36.3 8.16,74.83 7.78,75.21 7.78,78.13 7.27,78.64 6.25,78.64 ; FPC4#20.2 74.08,43.72 74.71,43.08 75.34,43.08 75.37,43.11 75.49,43.11 75.89,43.51 75.89,46.42 76.36,46.9 FPC3#33.2 78.27,46.9 78.64,47.27 78.64,48.42 78.01,49.05 74.84,49.05 74.58,49.32 FPC2.2 ; 60.86,78.64 61.88,78.64 62.39,78.13 62.39,75.21 62.77,74.83 FPC3#25.3 64.24,74.83 64.85,74.22 64.85,73.44 64.18,72.77 61.09,72.77 60.86,72.54 FPC4#25.3 ; FPC4#35.3 6.25,45.11 6.48,45.34 9.57,45.34 10.24,46.01 10.24,46.78 9.63,47.4 FPC3#10.3 8.16,47.4 7.78,47.78 7.78,50.7 7.27,51.21 6.25,51.21 ; 60.86,23.78 61.88,23.78 62.39,23.27 62.39,20.35 62.77,19.96 FPC3#13.3 64.24,19.96 64.85,19.35 64.85,18.58 64.18,17.91 61.09,17.91 60.86,17.68 FPC4.3 ; FPC4#26.2 19.47,71.15 20.1,70.51 20.73,70.51 20.76,70.54 20.88,70.54 21.28,70.94 21.28,73.86 21.75,74.33 FPC3#16.2 23.66,74.33 24.03,74.7 24.03,75.85 23.4,76.48 20.23,76.48 19.97,76.75 FPC2#30.2 ; FPC4#2.2 46.77,2.57 47.41,1.93 48.04,1.93 48.06,1.96 48.18,1.96 48.59,2.36 48.59,5.28 49.06,5.75 FPC3#34.2 50.96,5.75 51.34,6.12 51.34,7.27 50.7,7.9 47.54,7.9 47.27,8.17 FPC2#22.2 ; FPC4#9.2 74.08,57.44 74.71,56.8 75.34,56.8 75.37,56.82 75.49,56.82 75.89,57.22 75.89,60.14 76.36,60.61 FPC3#11.2 78.27,60.61 78.64,60.99 78.64,62.13 78.01,62.77 74.84,62.77 74.58,63.03 FPC2#31.2 ; FPC4#18.3 6.25,31.39 6.48,31.63 9.57,31.63 10.24,32.29 10.24,33.07 9.63,33.68 FPC3#27.3 8.16,33.68 7.78,34.06 7.78,36.99 7.27,37.49 6.25,37.49 ; FPC2#3.2 74.58,76.75 74.84,76.48 78.01,76.48 78.64,75.85 78.64,74.7 78.27,74.33 FPC3#4.2 76.36,74.33 75.89,73.86 75.89,70.94 75.49,70.54 75.37,70.54 75.34,70.51 74.71,70.51 74.08,71.15 FPC4#16.2 ; 60.86,10.06 61.88,10.06 62.39,9.55 62.39,6.63 62.77,6.25 FPC3#5.3 64.24,6.25 64.85,5.63 64.85,4.86 64.18,4.19 61.09,4.19 60.86,3.96 FPC4#27.3 ; 60.86,51.21 61.88,51.21 62.39,50.7 62.39,47.78 62.77,47.4 FPC3#32.3 64.24,47.4 64.85,46.78 64.85,46.01 64.18,45.34 61.09,45.34 60.86,45.11 FPC4#33.3 ; FPC2#16.2 47.27,21.89 47.54,21.62 50.7,21.62 51.34,20.98 51.34,19.84 50.96,19.46 FPC3#18.2 49.06,19.46 48.59,18.99 48.59,16.08 48.18,15.68 48.06,15.68 48.04,15.65 47.41,15.65 46.77,16.29 FPC4#32.2 ; FPC4#31.2 74.08,16.29 74.71,15.65 75.34,15.65 75.37,15.68 75.49,15.68 75.89,16.08 75.89,18.99 76.36,19.46 FPC3#3.2 78.27,19.46 78.64,19.84 78.64,20.98 78.01,21.62 74.84,21.62 74.58,21.89 FPC2#20.2 ; FPC4#23.3 33.55,45.11 33.79,45.34 36.88,45.34 37.54,46.01 37.54,46.78 36.93,47.4 FPC3#26.3 35.47,47.4 35.08,47.78 35.08,50.7 34.57,51.21 33.56,51.21 ; FPC4#36.3 33.55,72.54 33.79,72.77 36.88,72.77 37.54,73.44 37.54,74.22 36.93,74.83 FPC3#20.3 35.47,74.83 35.08,75.21 35.08,78.13 34.57,78.64 33.56,78.64 ; FPC4#14.2 46.77,71.15 47.41,70.51 48.04,70.51 48.06,70.54 48.18,70.54 48.59,70.94 48.59,73.86 49.06,74.33 FPC3#21.2 50.96,74.33 51.34,74.7 51.34,75.85 50.7,76.48 47.54,76.48 47.27,76.75 FPC2#2.2 ; FPC2#18.2 74.58,35.6 74.84,35.33 78.01,35.33 78.64,34.7 78.64,33.56 78.27,33.18 FPC3#23.2 76.36,33.18 75.89,32.71 75.89,29.79 75.49,29.39 75.37,29.39 75.34,29.37 74.71,29.37 74.08,30 FPC4#29.2 ; 33.56,10.06 34.57,10.06 35.08,9.55 35.08,6.63 35.47,6.25 FPC3#14.3 36.93,6.25 37.54,5.63 37.54,4.86 36.88,4.19 33.79,4.19 33.55,3.96 FPC4#17.3 ; FPC2#15.2 74.58,8.17 74.84,7.9 78.01,7.9 78.64,7.27 78.64,6.12 78.27,5.75 FPC3#35.2 76.36,5.75 75.89,5.28 75.89,2.36 75.49,1.96 75.37,1.96 75.34,1.93 74.71,1.93 74.08,2.57 FPC4#5.2 ; FPC4#21.2 46.77,57.44 47.41,56.8 48.04,56.8 48.06,56.82 48.18,56.82 48.59,57.22 48.59,60.14 49.06,60.61 FPC3#24.2 50.96,60.61 51.34,60.99 51.34,62.13 50.7,62.77 47.54,62.77 47.27,63.03 FPC2#26.2 ; FPC2#24.2 47.27,49.32 47.54,49.05 50.7,49.05 51.34,48.42 51.34,47.27 50.96,46.9 FPC3#22.2 49.06,46.9 48.59,46.42 48.59,43.51 48.18,43.11 48.06,43.11 48.04,43.08 47.41,43.08 46.77,43.72 FPC4#10.2 ; FPC4#24.2 46.77,30 47.41,29.37 48.04,29.37 48.06,29.39 48.18,29.39 48.59,29.79 48.59,32.71 49.06,33.18 FPC3#9.2 50.96,33.18 51.34,33.56 51.34,34.7 50.7,35.33 47.54,35.33 47.27,35.6 FPC2#27.2 ; FPC4#11.3 6.25,58.83 6.48,59.06 9.57,59.06 10.24,59.73 10.24,60.5 9.63,61.11 FPC3#8.3 8.16,61.11 7.78,61.5 7.78,64.42 7.27,64.93 6.25,64.93 ; FPC4#3.3 33.55,58.83 33.79,59.06 36.88,59.06 37.54,59.73 37.54,60.5 36.93,61.11 FPC3#17.3 35.47,61.11 35.08,61.5 35.08,64.42 34.57,64.93 33.56,64.93 ; FPC4#4.2 19.47,57.44 20.1,56.8 20.73,56.8 20.76,56.82 20.88,56.82 21.28,57.22 21.28,60.14 21.75,60.61 FPC3#19.2 23.66,60.61 24.03,60.99 24.03,62.13 23.4,62.77 20.23,62.77 19.97,63.03 FPC2#28.2 ; FPC2#29.2 19.97,49.32 20.23,49.05 23.4,49.05 24.03,48.42 24.03,47.27 23.66,46.9 FPC3#28.2 21.75,46.9 21.28,46.42 21.28,43.51 20.88,43.11 20.76,43.11 20.73,43.08 20.1,43.08 19.47,43.72 FPC4#22.2 ; FPC2#14.2 19.97,8.17 20.23,7.9 23.4,7.9 24.03,7.27 24.03,6.12 23.66,5.75 FPC3#29.2 21.75,5.75 21.28,5.28 21.28,2.36 20.88,1.96 20.76,1.96 20.73,1.93 20.1,1.93 19.47,2.57 FPC4#34.2 ; FPC4#6.3 6.25,17.68 6.48,17.91 9.57,17.91 10.24,18.58 10.24,19.35 9.63,19.96 FPC3#12.3 8.16,19.96 7.78,20.35 7.78,23.27 7.27,23.78 6.25,23.78 ; FPC4#12.3 60.86,31.39 61.09,31.63 64.18,31.63 64.85,32.29 64.85,33.07 64.24,33.68 FPC3#31.3 62.77,33.68 62.39,34.06 62.39,36.99 61.88,37.49 60.86,37.49 ; FPC2#5.2 19.97,21.89 20.23,21.62 23.4,21.62 24.03,20.98 24.03,19.84 23.66,19.46 FPC3#2.2 21.75,19.46 21.28,18.99 21.28,16.08 20.88,15.68 20.76,15.68 20.73,15.65 20.1,15.65 19.47,16.29 FPC4#28.2 ; 6.25,10.06 7.27,10.06 7.78,9.55 7.78,6.63 8.16,6.25 FPC3#15.3 9.63,6.25 10.24,5.63 10.24,4.86 9.57,4.19 6.48,4.19 6.25,3.96 FPC4#7.3 ; FPC4#30.3 60.86,58.83 61.09,59.06 64.18,59.06 64.85,59.73 64.85,60.5 64.24,61.11 FPC3#30.3 62.77,61.11 62.39,61.5 62.39,64.42 61.88,64.93 60.86,64.93 ; 33.56,37.49 34.57,37.49 35.08,36.99 35.08,34.06 35.47,33.68 FPC3.3 36.93,33.68 37.54,33.07 37.54,32.29 36.88,31.63 33.79,31.63 33.55,31.39 FPC4#19.3 ; FPC4#8.3 33.55,17.68 33.79,17.91 36.88,17.91 37.54,18.58 37.54,19.35 36.93,19.96 FPC3#6.3 35.47,19.96 35.08,20.35 35.08,23.27 34.57,23.78 33.56,23.78